# EAGLE board Resistor_Resistor (EAGLE 8.3.0), part 4 of 32
## Placement (x,y rotation side) (continued)
R3936  10K  [0201]  48.51,83.57 0 top
R3937  10K  [0201]  48.51,84.18 0 top
R3938  10K  [0201]  48.51,84.79 0 top
R3939  10K  [0201]  48.51,85.39 0 top
R3940  10K  [0201]  48.51,86 0 top
R3941  10K  [0201]  48.51,86.61 0 top
R3942  10K  [0201]  48.51,87.22 0 top
R3943  10K  [0201]  48.51,87.83 0 top
R3944  10K  [0201]  48.51,88.44 0 top
R3945  10K  [0201]  48.51,89.05 0 top
R3946  10K  [0201]  48.51,89.66 0 top
R3947  10K  [0201]  48.51,90.27 0 top
R3948  10K  [0201]  48.51,90.88 0 top
R3949  10K  [0201]  48.51,91.49 0 top
R3950  10K  [0201]  48.51,92.1 0 top
R3951  10K  [0201]  48.51,92.71 0 top
R3952  10K  [0201]  48.51,93.32 0 top
R3953  10K  [0201]  48.51,93.93 0 top
R3954  10K  [0201]  48.51,94.54 0 top
R3955  10K  [0201]  48.51,95.15 0 top
R3956  10K  [0201]  48.51,95.76 0 top
R3957  10K  [0201]  48.51,96.37 0 top
R3958  10K  [0201]  48.51,96.98 0 top
R3959  10K  [0201]  48.51,97.59 0 top
R3960  10K  [0201]  48.51,98.2 0 top
R3961  10K  [0201]  48.51,98.81 0 top
R3962  10K  [0201]  48.51,99.42 0 top
R3963  10K  [0201]  48.51,100.03 0 top
R3964  10K  [0201]  48.51,100.63 0 top
R3965  10K  [0201]  48.51,101.24 0 top
R3966  10K  [0201]  48.51,101.85 0 top
R3967  10K  [0201]  48.51,102.46 0 top
R3968  10K  [0201]  48.51,103.07 0 top
R3969  10K  [0201]  48.51,103.68 0 top
R3970  10K  [0201]  48.51,104.29 0 top
R3971  10K  [0201]  48.51,104.9 0 top
R3972  10K  [0201]  48.51,105.51 0 top
R3973  10K  [0201]  48.51,106.12 0 top
R3974  10K  [0201]  48.51,106.73 0 top
R3975  10K  [0201]  48.51,107.34 0 top
R3976  10K  [0201]  48.51,107.95 0 top
R3977  10K  [0201]  48.51,108.56 0 top
R3978  10K  [0201]  48.51,109.17 0 top
R3979  10K  [0201]  48.51,109.78 0 top
R3980  10K  [0201]  48.51,110.39 0 top
R3981  10K  [0201]  48.51,111 0 top
R3982  10K  [0201]  48.51,111.61 0 top
R3983  10K  [0201]  48.51,112.22 0 top
R3984  10K  [0201]  48.51,112.83 0 top
R3985  10K  [0201]  48.51,113.44 0 top
R3986  10K  [0201]  48.51,114.05 0 top
R3987  10K  [0201]  48.51,114.66 0 top
R3988  10K  [0201]  48.51,115.27 0 top
R3989  10K  [0201]  48.51,115.87 0 top
R3990  10K  [0201]  48.51,116.48 0 top
R3991  10K  [0201]  48.51,117.09 0 top
R3992  10K  [0201]  48.51,117.7 0 top
R3993  10K  [0201]  48.51,118.31 0 top
R3994  10K  [0201]  48.51,118.92 0 top
R3995  10K  [0201]  48.51,119.53 0 top
R3996  10K  [0201]  48.51,120.14 0 top
R3997  10K  [0201]  48.51,120.75 0 top
R3998  10K  [0201]  48.51,121.36 0 top
R3999  10K  [0201]  48.51,121.97 0 top
R4000  10K  [0201]  48.51,122.58 0 top
R4001  10K  [0201]  49.73,1.27 0 top
R4002  10K  [0201]  49.73,1.88 0 top
R4003  10K  [0201]  49.73,2.49 0 top
R4004  10K  [0201]  49.73,3.1 0 top
R4005  10K  [0201]  49.73,3.71 0 top
R4006  10K  [0201]  49.73,4.32 0 top
R4007  10K  [0201]  49.73,4.93 0 top
R4008  10K  [0201]  49.73,5.54 0 top
R4009  10K  [0201]  49.73,6.15 0 top
R4010  10K  [0201]  49.73,6.76 0 top
R4011  10K  [0201]  49.73,7.37 0 top
R4012  10K  [0201]  49.73,7.98 0 top
R4013  10K  [0201]  49.73,8.59 0 top
R4014  10K  [0201]  49.73,9.19 0 top
R4015  10K  [0201]  49.73,9.8 0 top
R4016  10K  [0201]  49.73,10.41 0 top
R4017  10K  [0201]  49.73,11.02 0 top
R4018  10K  [0201]  49.73,11.63 0 top
R4019  10K  [0201]  49.73,12.24 0 top
R4020  10K  [0201]  49.73,12.85 0 top
R4021  10K  [0201]  49.73,13.46 0 top
R4022  10K  [0201]  49.73,14.07 0 top
R4023  10K  [0201]  49.73,14.68 0 top
R4024  10K  [0201]  49.73,15.29 0 top
R4025  10K  [0201]  49.73,15.9 0 top
R4026  10K  [0201]  49.73,16.51 0 top
R4027  10K  [0201]  49.73,17.12 0 top
R4028  10K  [0201]  49.73,17.73 0 top
R4029  10K  [0201]  49.73,18.34 0 top
R4030  10K  [0201]  49.73,18.95 0 top
R4031  10K  [0201]  49.73,19.56 0 top
R4032  10K  [0201]  49.73,20.17 0 top
R4033  10K  [0201]  49.73,20.78 0 top
R4034  10K  [0201]  49.73,21.39 0 top
R4035  10K  [0201]  49.73,22 0 top
R4036  10K  [0201]  49.73,22.61 0 top
R4037  10K  [0201]  49.73,23.22 0 top
R4038  10K  [0201]  49.73,23.83 0 top
R4039  10K  [0201]  49.73,24.43 0 top
R4040  10K  [0201]  49.73,25.04 0 top
R4041  10K  [0201]  49.73,25.65 0 top
R4042  10K  [0201]  49.73,26.26 0 top
R4043  10K  [0201]  49.73,26.87 0 top
R4044  10K  [0201]  49.73,27.48 0 top
R4045  10K  [0201]  49.73,28.09 0 top
R4046  10K  [0201]  49.73,28.7 0 top
R4047  10K  [0201]  49.73,29.31 0 top
R4048  10K  [0201]  49.73,29.92 0 top
R4049  10K  [0201]  49.73,30.53 0 top
R4050  10K  [0201]  49.73,31.14 0 top
R4051  10K  [0201]  49.73,31.75 0 top
R4052  10K  [0201]  49.73,32.36 0 top
R4053  10K  [0201]  49.73,32.97 0 top
R4054  10K  [0201]  49.73,33.58 0 top
R4055  10K  [0201]  49.73,34.19 0 top
R4056  10K  [0201]  49.73,34.8 0 top
R4057  10K  [0201]  49.73,35.41 0 top
R4058  10K  [0201]  49.73,36.02 0 top
R4059  10K  [0201]  49.73,36.63 0 top
R4060  10K  [0201]  49.73,37.24 0 top
R4061  10K  [0201]  49.73,37.85 0 top
R4062  10K  [0201]  49.73,38.46 0 top
R4063  10K  [0201]  49.73,39.07 0 top
R4064  10K  [0201]  49.73,39.67 0 top
R4065  10K  [0201]  49.73,40.28 0 top
R4066  10K  [0201]  49.73,40.89 0 top
R4067  10K  [0201]  49.73,41.5 0 top
R4068  10K  [0201]  49.73,42.11 0 top
R4069  10K  [0201]  49.73,42.72 0 top
R4070  10K  [0201]  49.73,43.33 0 top
R4071  10K  [0201]  49.73,43.94 0 top
R4072  10K  [0201]  49.73,44.55 0 top
R4073  10K  [0201]  49.73,45.16 0 top
R4074  10K  [0201]  49.73,45.77 0 top
R4075  10K  [0201]  49.73,46.38 0 top
R4076  10K  [0201]  49.73,46.99 0 top
R4077  10K  [0201]  49.73,47.6 0 top
R4078  10K  [0201]  49.73,48.21 0 top
R4079  10K  [0201]  49.73,48.82 0 top
R4080  10K  [0201]  49.73,49.43 0 top
R4081  10K  [0201]  49.73,50.04 0 top
R4082  10K  [0201]  49.73,50.65 0 top
R4083  10K  [0201]  49.73,51.26 0 top
R4084  10K  [0201]  49.73,51.87 0 top
R4085  10K  [0201]  49.73,52.48 0 top
R4086  10K  [0201]  49.73,53.09 0 top
R4087  10K  [0201]  49.73,53.7 0 top
R4088  10K  [0201]  49.73,54.31 0 top
R4089  10K  [0201]  49.73,54.91 0 top
R4090  10K  [0201]  49.73,55.52 0 top
R4091  10K  [0201]  49.73,56.13 0 top
R4092  10K  [0201]  49.73,56.74 0 top
R4093  10K  [0201]  49.73,57.35 0 top
R4094  10K  [0201]  49.73,57.96 0 top
R4095  10K  [0201]  49.73,58.57 0 top
R4096  10K  [0201]  49.73,59.18 0 top
R4097  10K  [0201]  49.73,59.79 0 top
R4098  10K  [0201]  49.73,60.4 0 top
R4099  10K  [0201]  49.73,61.01 0 top
R4100  10K  [0201]  49.73,61.62 0 top
R4101  10K  [0201]  49.73,62.23 0 top
R4102  10K  [0201]  49.73,62.84 0 top
R4103  10K  [0201]  49.73,63.45 0 top
R4104  10K  [0201]  49.73,64.06 0 top
R4105  10K  [0201]  49.73,64.67 0 top
R4106  10K  [0201]  49.73,65.28 0 top
R4107  10K  [0201]  49.73,65.89 0 top
R4108  10K  [0201]  49.73,66.5 0 top
R4109  10K  [0201]  49.73,67.11 0 top
R4110  10K  [0201]  49.73,67.72 0 top
R4111  10K  [0201]  49.73,68.33 0 top
R4112  10K  [0201]  49.73,68.94 0 top
R4113  10K  [0201]  49.73,69.55 0 top
R4114  10K  [0201]  49.73,70.15 0 top
R4115  10K  [0201]  49.73,70.76 0 top
R4116  10K  [0201]  49.73,71.37 0 top
R4117  10K  [0201]  49.73,71.98 0 top
R4118  10K  [0201]  49.73,72.59 0 top
R4119  10K  [0201]  49.73,73.2 0 top
R4120  10K  [0201]  49.73,73.81 0 top
R4121  10K  [0201]  49.73,74.42 0 top
R4122  10K  [0201]  49.73,75.03 0 top
R4123  10K  [0201]  49.73,75.64 0 top
R4124  10K  [0201]  49.73,76.25 0 top
R4125  10K  [0201]  49.73,76.86 0 top
R4126  10K  [0201]  49.73,77.47 0 top
R4127  10K  [0201]  49.73,78.08 0 top
R4128  10K  [0201]  49.73,78.69 0 top
R4129  10K  [0201]  49.73,79.3 0 top
R4130  10K  [0201]  49.73,79.91 0 top
R4131  10K  [0201]  49.73,80.52 0 top
R4132  10K  [0201]  49.73,81.13 0 top
R4133  10K  [0201]  49.73,81.74 0 top
R4134  10K  [0201]  49.73,82.35 0 top
R4135  10K  [0201]  49.73,82.96 0 top
R4136  10K  [0201]  49.73,83.57 0 top
R4137  10K  [0201]  49.73,84.18 0 top
R4138  10K  [0201]  49.73,84.79 0 top
R4139  10K  [0201]  49.73,85.39 0 top
R4140  10K  [0201]  49.73,86 0 top
R4141  10K  [0201]  49.73,86.61 0 top
R4142  10K  [0201]  49.73,87.22 0 top
R4143  10K  [0201]  49.73,87.83 0 top
R4144  10K  [0201]  49.73,88.44 0 top
R4145  10K  [0201]  49.73,89.05 0 top
R4146  10K  [0201]  49.73,89.66 0 top
R4147  10K  [0201]  49.73,90.27 0 top
R4148  10K  [0201]  49.73,90.88 0 top
R4149  10K  [0201]  49.73,91.49 0 top
R4150  10K  [0201]  49.73,92.1 0 top
R4151  10K  [0201]  49.73,92.71 0 top
R4152  10K  [0201]  49.73,93.32 0 top
R4153  10K  [0201]  49.73,93.93 0 top
R4154  10K  [0201]  49.73,94.54 0 top
R4155  10K  [0201]  49.73,95.15 0 top
R4156  10K  [0201]  49.73,95.76 0 top
R4157  10K  [0201]  49.73,96.37 0 top
R4158  10K  [0201]  49.73,96.98 0 top
R4159  10K  [0201]  49.73,97.59 0 top
R4160  10K  [0201]  49.73,98.2 0 top
R4161  10K  [0201]  49.73,98.81 0 top
R4162  10K  [0201]  49.73,99.42 0 top
R4163  10K  [0201]  49.73,100.03 0 top
R4164  10K  [0201]  49.73,100.63 0 top
R4165  10K  [0201]  49.73,101.24 0 top
R4166  10K  [0201]  49.73,101.85 0 top
R4167  10K  [0201]  49.73,102.46 0 top
R4168  10K  [0201]  49.73,103.07 0 top
R4169  10K  [0201]  49.73,103.68 0 top
R4170  10K  [0201]  49.73,104.29 0 top
R4171  10K  [0201]  49.73,104.9 0 top
R4172  10K  [0201]  49.73,105.51 0 top
R4173  10K  [0201]  49.73,106.12 0 top
R4174  10K  [0201]  49.73,106.73 0 top
R4175  10K  [0201]  49.73,107.34 0 top
R4176  10K  [0201]  49.73,107.95 0 top
R4177  10K  [0201]  49.73,108.56 0 top
R4178  10K  [0201]  49.73,109.17 0 top
R4179  10K  [0201]  49.73,109.78 0 top
R4180  10K  [0201]  49.73,110.39 0 top
R4181  10K  [0201]  49.73,111 0 top
R4182  10K  [0201]  49.73,111.61 0 top
R4183  10K  [0201]  49.73,112.22 0 top
R4184  10K  [0201]  49.73,112.83 0 top
R4185  10K  [0201]  49.73,113.44 0 top
R4186  10K  [0201]  49.73,114.05 0 top
R4187  10K  [0201]  49.73,114.66 0 top
R4188  10K  [0201]  49.73,115.27 0 top
R4189  10K  [0201]  49.73,115.87 0 top
R4190  10K  [0201]  49.73,116.48 0 top
R4191  10K  [0201]  49.73,117.09 0 top
R4192  10K  [0201]  49.73,117.7 0 top
R4193  10K  [0201]  49.73,118.31 0 top
R4194  10K  [0201]  49.73,118.92 0 top
R4195  10K  [0201]  49.73,119.53 0 top
R4196  10K  [0201]  49.73,120.14 0 top
R4197  10K  [0201]  49.73,120.75 0 top
R4198  10K  [0201]  49.73,121.36 0 top
R4199  10K  [0201]  49.73,121.97 0 top
R4200  10K  [0201]  49.73,122.58 0 top
R4201  10K  [0201]  50.95,1.27 0 top
R4202  10K  [0201]  50.95,1.88 0 top
R4203  10K  [0201]  50.95,2.49 0 top
R4204  10K  [0201]  50.95,3.1 0 top
R4205  10K  [0201]  50.95,3.71 0 top
R4206  10K  [0201]  50.95,4.32 0 top
R4207  10K  [0201]  50.95,4.93 0 top
R4208  10K  [0201]  50.95,5.54 0 top
R4209  10K  [0201]  50.95,6.15 0 top
R4210  10K  [0201]  50.95,6.76 0 top
R4211  10K  [0201]  50.95,7.37 0 top
R4212  10K  [0201]  50.95,7.98 0 top
R4213  10K  [0201]  50.95,8.59 0 top
R4214  10K  [0201]  50.95,9.19 0 top
R4215  10K  [0201]  50.95,9.8 0 top
R4216  10K  [0201]  50.95,10.41 0 top
R4217  10K  [0201]  50.95,11.02 0 top
R4218  10K  [0201]  50.95,11.63 0 top
R4219  10K  [0201]  50.95,12.24 0 top
R4220  10K  [0201]  50.95,12.85 0 top
R4221  10K  [0201]  50.95,13.46 0 top
R4222  10K  [0201]  50.95,14.07 0 top
R4223  10K  [0201]  50.95,14.68 0 top
R4224  10K  [0201]  50.95,15.29 0 top
R4225  10K  [0201]  50.95,15.9 0 top
R4226  10K  [0201]  50.95,16.51 0 top
R4227  10K  [0201]  50.95,17.12 0 top
R4228  10K  [0201]  50.95,17.73 0 top
R4229  10K  [0201]  50.95,18.34 0 top
R4230  10K  [0201]  50.95,18.95 0 top
R4231  10K  [0201]  50.95,19.56 0 top
R4232  10K  [0201]  50.95,20.17 0 top
R4233  10K  [0201]  50.95,20.78 0 top
R4234  10K  [0201]  50.95,21.39 0 top
R4235  10K  [0201]  50.95,22 0 top
R4236  10K  [0201]  50.95,22.61 0 top
R4237  10K  [0201]  50.95,23.22 0 top
R4238  10K  [0201]  50.95,23.83 0 top
R4239  10K  [0201]  50.95,24.43 0 top
R4240  10K  [0201]  50.95,25.04 0 top
R4241  10K  [0201]  50.95,25.65 0 top
R4242  10K  [0201]  50.95,26.26 0 top
R4243  10K  [0201]  50.95,26.87 0 top
R4244  10K  [0201]  50.95,27.48 0 top
R4245  10K  [0201]  50.95,28.09 0 top
R4246  10K  [0201]  50.95,28.7 0 top
R4247  10K  [0201]  50.95,29.31 0 top
R4248  10K  [0201]  50.95,29.92 0 top
R4249  10K  [0201]  50.95,30.53 0 top
R4250  10K  [0201]  50.95,31.14 0 top
R4251  10K  [0201]  50.95,31.75 0 top
R4252  10K  [0201]  50.95,32.36 0 top
R4253  10K  [0201]  50.95,32.97 0 top
R4254  10K  [0201]  50.95,33.58 0 top
R4255  10K  [0201]  50.95,34.19 0 top
R4256  10K  [0201]  50.95,34.8 0 top
R4257  10K  [0201]  50.95,35.41 0 top
R4258  10K  [0201]  50.95,36.02 0 top
R4259  10K  [0201]  50.95,36.63 0 top
R4260  10K  [0201]  50.95,37.24 0 top
R4261  10K  [0201]  50.95,37.85 0 top
R4262  10K  [0201]  50.95,38.46 0 top
R4263  10K  [0201]  50.95,39.07 0 top
R4264  10K  [0201]  50.95,39.67 0 top
R4265  10K  [0201]  50.95,40.28 0 top
R4266  10K  [0201]  50.95,40.89 0 top
R4267  10K  [0201]  50.95,41.5 0 top
R4268  10K  [0201]  50.95,42.11 0 top
R4269  10K  [0201]  50.95,42.72 0 top
R4270  10K  [0201]  50.95,43.33 0 top
R4271  10K  [0201]  50.95,43.94 0 top
R4272  10K  [0201]  50.95,44.55 0 top
R4273  10K  [0201]  50.95,45.16 0 top
R4274  10K  [0201]  50.95,45.77 0 top
R4275  10K  [0201]  50.95,46.38 0 top
R4276  10K  [0201]  50.95,46.99 0 top
R4277  10K  [0201]  50.95,47.6 0 top
R4278  10K  [0201]  50.95,48.21 0 top
R4279  10K  [0201]  50.95,48.82 0 top
R4280  10K  [0201]  50.95,49.43 0 top
R4281  10K  [0201]  50.95,50.04 0 top
R4282  10K  [0201]  50.95,50.65 0 top
R4283  10K  [0201]  50.95,51.26 0 top
R4284  10K  [0201]  50.95,51.87 0 top
R4285  10K  [0201]  50.95,52.48 0 top
R4286  10K  [0201]  50.95,53.09 0 top
R4287  10K  [0201]  50.95,53.7 0 top
R4288  10K  [0201]  50.95,54.31 0 top
R4289  10K  [0201]  50.95,54.91 0 top
R4290  10K  [0201]  50.95,55.52 0 top
R4291  10K  [0201]  50.95,56.13 0 top
R4292  10K  [0201]  50.95,56.74 0 top
R4293  10K  [0201]  50.95,57.35 0 top
R4294  10K  [0201]  50.95,57.96 0 top
R4295  10K  [0201]  50.95,58.57 0 top
R4296  10K  [0201]  50.95,59.18 0 top
R4297  10K  [0201]  50.95,59.79 0 top
R4298  10K  [0201]  50.95,60.4 0 top
R4299  10K  [0201]  50.95,61.01 0 top
R4300  10K  [0201]  50.95,61.62 0 top
R4301  10K  [0201]  50.95,62.23 0 top
R4302  10K  [0201]  50.95,62.84 0 top
R4303  10K  [0201]  50.95,63.45 0 top
R4304  10K  [0201]  50.95,64.06 0 top
R4305  10K  [0201]  50.95,64.67 0 top
R4306  10K  [0201]  50.95,65.28 0 top
R4307  10K  [0201]  50.95,65.89 0 top
R4308  10K  [0201]  50.95,66.5 0 top
R4309  10K  [0201]  50.95,67.11 0 top
R4310  10K  [0201]  50.95,67.72 0 top
R4311  10K  [0201]  50.95,68.33 0 top
R4312  10K  [0201]  50.95,68.94 0 top
R4313  10K  [0201]  50.95,69.55 0 top
R4314  10K  [0201]  50.95,70.15 0 top
R4315  10K  [0201]  50.95,70.76 0 top
R4316  10K  [0201]  50.95,71.37 0 top
R4317  10K  [0201]  50.95,71.98 0 top
R4318  10K  [0201]  50.95,72.59 0 top
R4319  10K  [0201]  50.95,73.2 0 top
R4320  10K  [0201]  50.95,73.81 0 top
R4321  10K  [0201]  50.95,74.42 0 top
R4322  10K  [0201]  50.95,75.03 0 top
R4323  10K  [0201]  50.95,75.64 0 top
R4324  10K  [0201]  50.95,76.25 0 top
R4325  10K  [0201]  50.95,76.86 0 top
R4326  10K  [0201]  50.95,77.47 0 top
R4327  10K  [0201]  50.95,78.08 0 top
R4328  10K  [0201]  50.95,78.69 0 top
R4329  10K  [0201]  50.95,79.3 0 top
R4330  10K  [0201]  50.95,79.91 0 top
R4331  10K  [0201]  50.95,80.52 0 top
R4332  10K  [0201]  50.95,81.13 0 top
R4333  10K  [0201]  50.95,81.74 0 top
R4334  10K  [0201]  50.95,82.35 0 top
R4335  10K  [0201]  50.95,82.96 0 top
R4336  10K  [0201]  50.95,83.57 0 top
R4337  10K  [0201]  50.95,84.18 0 top
R4338  10K  [0201]  50.95,84.79 0 top
R4339  10K  [0201]  50.95,85.39 0 top
R4340  10K  [0201]  50.95,86 0 top
R4341  10K  [0201]  50.95,86.61 0 top
R4342  10K  [0201]  50.95,87.22 0 top
R4343  10K  [0201]  50.95,87.83 0 top
R4344  10K  [0201]  50.95,88.44 0 top
R4345  10K  [0201]  50.95,89.05 0 top
R4346  10K  [0201]  50.95,89.66 0 top
R4347  10K  [0201]  50.95,90.27 0 top
R4348  10K  [0201]  50.95,90.88 0 top
R4349  10K  [0201]  50.95,91.49 0 top
R4350  10K  [0201]  50.95,92.1 0 top
R4351  10K  [0201]  50.95,92.71 0 top
R4352  10K  [0201]  50.95,93.32 0 top
R4353  10K  [0201]  50.95,93.93 0 top
R4354  10K  [0201]  50.95,94.54 0 top
R4355  10K  [0201]  50.95,95.15 0 top
R4356  10K  [0201]  50.95,95.76 0 top
R4357  10K  [0201]  50.95,96.37 0 top
R4358  10K  [0201]  50.95,96.98 0 top
R4359  10K  [0201]  50.95,97.59 0 top
R4360  10K  [0201]  50.95,98.2 0 top
R4361  10K  [0201]  50.95,98.81 0 top
R4362  10K  [0201]  50.95,99.42 0 top
R4363  10K  [0201]  50.95,100.03 0 top
R4364  10K  [0201]  50.95,100.63 0 top
R4365  10K  [0201]  50.95,101.24 0 top
R4366  10K  [0201]  50.95,101.85 0 top
R4367  10K  [0201]  50.95,102.46 0 top
R4368  10K  [0201]  50.95,103.07 0 top
R4369  10K  [0201]  50.95,103.68 0 top
R4370  10K  [0201]  50.95,104.29 0 top
R4371  10K  [0201]  50.95,104.9 0 top
R4372  10K  [0201]  50.95,105.51 0 top
R4373  10K  [0201]  50.95,106.12 0 top
R4374  10K  [0201]  50.95,106.73 0 top
R4375  10K  [0201]  50.95,107.34 0 top
R4376  10K  [0201]  50.95,107.95 0 top
R4377  10K  [0201]  50.95,108.56 0 top
R4378  10K  [0201]  50.95,109.17 0 top
R4379  10K  [0201]  50.95,109.78 0 top
R4380  10K  [0201]  50.95,110.39 0 top
R4381  10K  [0201]  50.95,111 0 top
R4382  10K  [0201]  50.95,111.61 0 top
R4383  10K  [0201]  50.95,112.22 0 top
R4384  10K  [0201]  50.95,112.83 0 top
R4385  10K  [0201]  50.95,113.44 0 top
R4386  10K  [0201]  50.95,114.05 0 top
R4387  10K  [0201]  50.95,114.66 0 top
R4388  10K  [0201]  50.95,115.27 0 top
R4389  10K  [0201]  50.95,115.87 0 top
R4390  10K  [0201]  50.95,116.48 0 top
R4391  10K  [0201]  50.95,117.09 0 top
R4392  10K  [0201]  50.95,117.7 0 top
R4393  10K  [0201]  50.95,118.31 0 top
R4394  10K  [0201]  50.95,118.92 0 top
R4395  10K  [0201]  50.95,119.53 0 top
R4396  10K  [0201]  50.95,120.14 0 top
R4397  10K  [0201]  50.95,120.75 0 top
R4398  10K  [0201]  50.95,121.36 0 top
R4399  10K  [0201]  50.95,121.97 0 top
R4400  10K  [0201]  50.95,122.58 0 top
R4401  10K  [0201]  52.17,1.27 0 top
R4402  10K  [0201]  52.17,1.88 0 top
R4403  10K  [0201]  52.17,2.49 0 top
R4404  10K  [0201]  52.17,3.1 0 top
R4405  10K  [0201]  52.17,3.71 0 top
R4406  10K  [0201]  52.17,4.32 0 top
R4407  10K  [0201]  52.17,4.93 0 top
R4408  10K  [0201]  52.17,5.54 0 top
R4409  10K  [0201]  52.17,6.15 0 top
R4410  10K  [0201]  52.17,6.76 0 top
R4411  10K  [0201]  52.17,7.37 0 top
R4412  10K  [0201]  52.17,7.98 0 top
R4413  10K  [0201]  52.17,8.59 0 top
R4414  10K  [0201]  52.17,9.19 0 top
R4415  10K  [0201]  52.17,9.8 0 top
R4416  10K  [0201]  52.17,10.41 0 top
R4417  10K  [0201]  52.17,11.02 0 top
R4418  10K  [0201]  52.17,11.63 0 top
R4419  10K  [0201]  52.17,12.24 0 top
R4420  10K  [0201]  52.17,12.85 0 top
R4421  10K  [0201]  52.17,13.46 0 top
R4422  10K  [0201]  52.17,14.07 0 top
R4423  10K  [0201]  52.17,14.68 0 top
R4424  10K  [0201]  52.17,15.29 0 top
R4425  10K  [0201]  52.17,15.9 0 top
R4426  10K  [0201]  52.17,16.51 0 top
R4427  10K  [0201]  52.17,17.12 0 top
R4428  10K  [0201]  52.17,17.73 0 top
R4429  10K  [0201]  52.17,18.34 0 top
R4430  10K  [0201]  52.17,18.95 0 top
R4431  10K  [0201]  52.17,19.56 0 top
R4432  10K  [0201]  52.17,20.17 0 top
R4433  10K  [0201]  52.17,20.78 0 top
R4434  10K  [0201]  52.17,21.39 0 top
R4435  10K  [0201]  52.17,22 0 top
R4436  10K  [0201]  52.17,22.61 0 top
R4437  10K  [0201]  52.17,23.22 0 top
R4438  10K  [0201]  52.17,23.83 0 top
R4439  10K  [0201]  52.17,24.43 0 top
R4440  10K  [0201]  52.17,25.04 0 top
R4441  10K  [0201]  52.17,25.65 0 top
R4442  10K  [0201]  52.17,26.26 0 top
R4443  10K  [0201]  52.17,26.87 0 top
R4444  10K  [0201]  52.17,27.48 0 top
R4445  10K  [0201]  52.17,28.09 0 top
R4446  10K  [0201]  52.17,28.7 0 top
R4447  10K  [0201]  52.17,29.31 0 top
R4448  10K  [0201]  52.17,29.92 0 top
R4449  10K  [0201]  52.17,30.53 0 top
R4450  10K  [0201]  52.17,31.14 0 top
R4451  10K  [0201]  52.17,31.75 0 top
R4452  10K  [0201]  52.17,32.36 0 top
R4453  10K  [0201]  52.17,32.97 0 top
R4454  10K  [0201]  52.17,33.58 0 top
R4455  10K  [0201]  52.17,34.19 0 top
R4456  10K  [0201]  52.17,34.8 0 top
R4457  10K  [0201]  52.17,35.41 0 top
R4458  10K  [0201]  52.17,36.02 0 top
R4459  10K  [0201]  52.17,36.63 0 top
R4460  10K  [0201]  52.17,37.24 0 top
R4461  10K  [0201]  52.17,37.85 0 top
R4462  10K  [0201]  52.17,38.46 0 top
R4463  10K  [0201]  52.17,39.07 0 top
R4464  10K  [0201]  52.17,39.67 0 top
R4465  10K  [0201]  52.17,40.28 0 top
R4466  10K  [0201]  52.17,40.89 0 top
R4467  10K  [0201]  52.17,41.5 0 top
R4468  10K  [0201]  52.17,42.11 0 top
R4469  10K  [0201]  52.17,42.72 0 top
R4470  10K  [0201]  52.17,43.33 0 top
R4471  10K  [0201]  52.17,43.94 0 top
R4472  10K  [0201]  52.17,44.55 0 top
R4473  10K  [0201]  52.17,45.16 0 top
R4474  10K  [0201]  52.17,45.77 0 top
R4475  10K  [0201]  52.17,46.38 0 top
R4476  10K  [0201]  52.17,46.99 0 top
R4477  10K  [0201]  52.17,47.6 0 top
R4478  10K  [0201]  52.17,48.21 0 top
R4479  10K  [0201]  52.17,48.82 0 top
R4480  10K  [0201]  52.17,49.43 0 top
R4481  10K  [0201]  52.17,50.04 0 top
R4482  10K  [0201]  52.17,50.65 0 top
R4483  10K  [0201]  52.17,51.26 0 top
R4484  10K  [0201]  52.17,51.87 0 top
R4485  10K  [0201]  52.17,52.48 0 top
R4486  10K  [0201]  52.17,53.09 0 top
R4487  10K  [0201]  52.17,53.7 0 top
R4488  10K  [0201]  52.17,54.31 0 top
R4489  10K  [0201]  52.17,54.91 0 top
R4490  10K  [0201]  52.17,55.52 0 top
R4491  10K  [0201]  52.17,56.13 0 top
R4492  10K  [0201]  52.17,56.74 0 top
R4493  10K  [0201]  52.17,57.35 0 top
R4494  10K  [0201]  52.17,57.96 0 top
R4495  10K  [0201]  52.17,58.57 0 top
R4496  10K  [0201]  52.17,59.18 0 top
R4497  10K  [0201]  52.17,59.79 0 top
R4498  10K  [0201]  52.17,60.4 0 top
R4499  10K  [0201]  52.17,61.01 0 top
R4500  10K  [0201]  52.17,61.62 0 top
R4501  10K  [0201]  52.17,62.23 0 top
R4502  10K  [0201]  52.17,62.84 0 top
R4503  10K  [0201]  52.17,63.45 0 top
R4504  10K  [0201]  52.17,64.06 0 top
R4505  10K  [0201]  52.17,64.67 0 top
R4506  10K  [0201]  52.17,65.28 0 top
R4507  10K  [0201]  52.17,65.89 0 top
R4508  10K  [0201]  52.17,66.5 0 top
R4509  10K  [0201]  52.17,67.11 0 top
R4510  10K  [0201]  52.17,67.72 0 top
R4511  10K  [0201]  52.17,68.33 0 top
R4512  10K  [0201]  52.17,68.94 0 top
R4513  10K  [0201]  52.17,69.55 0 top
R4514  10K  [0201]  52.17,70.15 0 top
R4515  10K  [0201]  52.17,70.76 0 top
R4516  10K  [0201]  52.17,71.37 0 top
R4517  10K  [0201]  52.17,71.98 0 top
R4518  10K  [0201]  52.17,72.59 0 top
R4519  10K  [0201]  52.17,73.2 0 top
R4520  10K  [0201]  52.17,73.81 0 top
R4521  10K  [0201]  52.17,74.42 0 top
R4522  10K  [0201]  52.17,75.03 0 top
R4523  10K  [0201]  52.17,75.64 0 top
R4524  10K  [0201]  52.17,76.25 0 top
R4525  10K  [0201]  52.17,76.86 0 top
R4526  10K  [0201]  52.17,77.47 0 top
R4527  10K  [0201]  52.17,78.08 0 top
R4528  10K  [0201]  52.17,78.69 0 top
R4529  10K  [0201]  52.17,79.3 0 top
R4530  10K  [0201]  52.17,79.91 0 top
R4531  10K  [0201]  52.17,80.52 0 top
R4532  10K  [0201]  52.17,81.13 0 top
R4533  10K  [0201]  52.17,81.74 0 top
R4534  10K  [0201]  52.17,82.35 0 top
R4535  10K  [0201]  52.17,82.96 0 top
R4536  10K  [0201]  52.17,83.57 0 top
R4537  10K  [0201]  52.17,84.18 0 top
R4538  10K  [0201]  52.17,84.79 0 top
R4539  10K  [0201]  52.17,85.39 0 top
R4540  10K  [0201]  52.17,86 0 top
R4541  10K  [0201]  52.17,86.61 0 top
R4542  10K  [0201]  52.17,87.22 0 top
R4543  10K  [0201]  52.17,87.83 0 top
R4544  10K  [0201]  52.17,88.44 0 top
R4545  10K  [0201]  52.17,89.05 0 top
R4546  10K  [0201]  52.17,89.66 0 top
R4547  10K  [0201]  52.17,90.27 0 top
R4548  10K  [0201]  52.17,90.88 0 top
R4549  10K  [0201]  52.17,91.49 0 top
R4550  10K  [0201]  52.17,92.1 0 top
R4551  10K  [0201]  52.17,92.71 0 top
R4552  10K  [0201]  52.17,93.32 0 top
R4553  10K  [0201]  52.17,93.93 0 top
R4554  10K  [0201]  52.17,94.54 0 top
R4555  10K  [0201]  52.17,95.15 0 top
R4556  10K  [0201]  52.17,95.76 0 top
R4557  10K  [0201]  52.17,96.37 0 top
R4558  10K  [0201]  52.17,96.98 0 top
R4559  10K  [0201]  52.17,97.59 0 top
R4560  10K  [0201]  52.17,98.2 0 top
R4561  10K  [0201]  52.17,98.81 0 top
R4562  10K  [0201]  52.17,99.42 0 top
R4563  10K  [0201]  52.17,100.03 0 top
R4564  10K  [0201]  52.17,100.63 0 top
R4565  10K  [0201]  52.17,101.24 0 top
R4566  10K  [0201]  52.17,101.85 0 top
R4567  10K  [0201]  52.17,102.46 0 top
R4568  10K  [0201]  52.17,103.07 0 top
R4569  10K  [0201]  52.17,103.68 0 top
R4570  10K  [0201]  52.17,104.29 0 top
R4571  10K  [0201]  52.17,104.9 0 top
R4572  10K  [0201]  52.17,105.51 0 top
R4573  10K  [0201]  52.17,106.12 0 top
R4574  10K  [0201]  52.17,106.73 0 top
R4575  10K  [0201]  52.17,107.34 0 top
R4576  10K  [0201]  52.17,107.95 0 top
R4577  10K  [0201]  52.17,108.56 0 top
R4578  10K  [0201]  52.17,109.17 0 top
R4579  10K  [0201]  52.17,109.78 0 top
R4580  10K  [0201]  52.17,110.39 0 top
R4581  10K  [0201]  52.17,111 0 top
R4582  10K  [0201]  52.17,111.61 0 top
R4583  10K  [0201]  52.17,112.22 0 top
R4584  10K  [0201]  52.17,112.83 0 top
R4585  10K  [0201]  52.17,113.44 0 top
R4586  10K  [0201]  52.17,114.05 0 top
R4587  10K  [0201]  52.17,114.66 0 top
R4588  10K  [0201]  52.17,115.27 0 top
R4589  10K  [0201]  52.17,115.87 0 top
R4590  10K  [0201]  52.17,116.48 0 top
R4591  10K  [0201]  52.17,117.09 0 top
R4592  10K  [0201]  52.17,117.7 0 top
R4593  10K  [0201]  52.17,118.31 0 top
R4594  10K  [0201]  52.17,118.92 0 top
R4595  10K  [0201]  52.17,119.53 0 top
R4596  10K  [0201]  52.17,120.14 0 top
R4597  10K  [0201]  52.17,120.75 0 top
R4598  10K  [0201]  52.17,121.36 0 top
R4599  10K  [0201]  52.17,121.97 0 top
R4600  10K  [0201]  52.17,122.58 0 top
R4601  10K  [0201]  53.39,1.27 0 top
R4602  10K  [0201]  53.39,1.88 0 top
R4603  10K  [0201]  53.39,2.49 0 top
R4604  10K  [0201]  53.39,3.1 0 top
R4605  10K  [0201]  53.39,3.71 0 top
R4606  10K  [0201]  53.39,4.32 0 top
R4607  10K  [0201]  53.39,4.93 0 top
R4608  10K  [0201]  53.39,5.54 0 top
R4609  10K  [0201]  53.39,6.15 0 top
R4610  10K  [0201]  53.39,6.76 0 top
R4611  10K  [0201]  53.39,7.37 0 top
R4612  10K  [0201]  53.39,7.98 0 top
R4613  10K  [0201]  53.39,8.59 0 top
R4614  10K  [0201]  53.39,9.19 0 top
R4615  10K  [0201]  53.39,9.8 0 top
R4616  10K  [0201]  53.39,10.41 0 top
R4617  10K  [0201]  53.39,11.02 0 top
R4618  10K  [0201]  53.39,11.63 0 top
R4619  10K  [0201]  53.39,12.24 0 top
R4620  10K  [0201]  53.39,12.85 0 top
R4621  10K  [0201]  53.39,13.46 0 top
R4622  10K  [0201]  53.39,14.07 0 top
R4623  10K  [0201]  53.39,14.68 0 top
R4624  10K  [0201]  53.39,15.29 0 top
R4625  10K  [0201]  53.39,15.9 0 top
R4626  10K  [0201]  53.39,16.51 0 top
R4627  10K  [0201]  53.39,17.12 0 top
R4628  10K  [0201]  53.39,17.73 0 top
R4629  10K  [0201]  53.39,18.34 0 top
R4630  10K  [0201]  53.39,18.95 0 top
R4631  10K  [0201]  53.39,19.56 0 top
R4632  10K  [0201]  53.39,20.17 0 top
R4633  10K  [0201]  53.39,20.78 0 top
R4634  10K  [0201]  53.39,21.39 0 top
R4635  10K  [0201]  53.39,22 0 top
R4636  10K  [0201]  53.39,22.61 0 top
R4637  10K  [0201]  53.39,23.22 0 top
R4638  10K  [0201]  53.39,23.83 0 top
R4639  10K  [0201]  53.39,24.43 0 top
R4640  10K  [0201]  53.39,25.04 0 top
R4641  10K  [0201]  53.39,25.65 0 top
R4642  10K  [0201]  53.39,26.26 0 top
R4643  10K  [0201]  53.39,26.87 0 top
R4644  10K  [0201]  53.39,27.48 0 top
R4645  10K  [0201]  53.39,28.09 0 top
R4646  10K  [0201]  53.39,28.7 0 top
R4647  10K  [0201]  53.39,29.31 0 top
R4648  10K  [0201]  53.39,29.92 0 top
R4649  10K  [0201]  53.39,30.53 0 top
R4650  10K  [0201]  53.39,31.14 0 top
R4651  10K  [0201]  53.39,31.75 0 top
R4652  10K  [0201]  53.39,32.36 0 top
R4653  10K  [0201]  53.39,32.97 0 top
R4654  10K  [0201]  53.39,33.58 0 top
R4655  10K  [0201]  53.39,34.19 0 top
R4656  10K  [0201]  53.39,34.8 0 top
R4657  10K  [0201]  53.39,35.41 0 top
R4658  10K  [0201]  53.39,36.02 0 top
R4659  10K  [0201]  53.39,36.63 0 top
R4660  10K  [0201]  53.39,37.24 0 top
R4661  10K  [0201]  53.39,37.85 0 top
R4662  10K  [0201]  53.39,38.46 0 top
R4663  10K  [0201]  53.39,39.07 0 top
R4664  10K  [0201]  53.39,39.67 0 top
R4665  10K  [0201]  53.39,40.28 0 top
R4666  10K  [0201]  53.39,40.89 0 top
R4667  10K  [0201]  53.39,41.5 0 top
R4668  10K  [0201]  53.39,42.11 0 top
R4669  10K  [0201]  53.39,42.72 0 top
R4670  10K  [0201]  53.39,43.33 0 top
R4671  10K  [0201]  53.39,43.94 0 top
R4672  10K  [0201]  53.39,44.55 0 top
R4673  10K  [0201]  53.39,45.16 0 top
R4674  10K  [0201]  53.39,45.77 0 top
R4675  10K  [0201]  53.39,46.38 0 top
R4676  10K  [0201]  53.39,46.99 0 top
R4677  10K  [0201]  53.39,47.6 0 top
R4678  10K  [0201]  53.39,48.21 0 top
R4679  10K  [0201]  53.39,48.82 0 top
R4680  10K  [0201]  53.39,49.43 0 top
R4681  10K  [0201]  53.39,50.04 0 top
R4682  10K  [0201]  53.39,50.65 0 top
R4683  10K  [0201]  53.39,51.26 0 top
R4684  10K  [0201]  53.39,51.87 0 top
R4685  10K  [0201]  53.39,52.48 0 top
R4686  10K  [0201]  53.39,53.09 0 top
R4687  10K  [0201]  53.39,53.7 0 top
R4688  10K  [0201]  53.39,54.31 0 top
R4689  10K  [0201]  53.39,54.91 0 top
R4690  10K  [0201]  53.39,55.52 0 top
R4691  10K  [0201]  53.39,56.13 0 top
R4692  10K  [0201]  53.39,56.74 0 top
R4693  10K  [0201]  53.39,57.35 0 top
R4694  10K  [0201]  53.39,57.96 0 top
R4695  10K  [0201]  53.39,58.57 0 top
R4696  10K  [0201]  53.39,59.18 0 top
R4697  10K  [0201]  53.39,59.79 0 top
R4698  10K  [0201]  53.39,60.4 0 top
R4699  10K  [0201]  53.39,61.01 0 top
R4700  10K  [0201]  53.39,61.62 0 top
R4701  10K  [0201]  53.39,62.23 0 top
R4702  10K  [0201]  53.39,62.84 0 top
R4703  10K  [0201]  53.39,63.45 0 top
R4704  10K  [0201]  53.39,64.06 0 top
R4705  10K  [0201]  53.39,64.67 0 top
R4706  10K  [0201]  53.39,65.28 0 top
R4707  10K  [0201]  53.39,65.89 0 top
R4708  10K  [0201]  53.39,66.5 0 top
R4709  10K  [0201]  53.39,67.11 0 top
R4710  10K  [0201]  53.39,67.72 0 top
R4711  10K  [0201]  53.39,68.33 0 top
R4712  10K  [0201]  53.39,68.94 0 top
R4713  10K  [0201]  53.39,69.55 0 top
R4714  10K  [0201]  53.39,70.15 0 top
R4715  10K  [0201]  53.39,70.76 0 top
R4716  10K  [0201]  53.39,71.37 0 top
R4717  10K  [0201]  53.39,71.98 0 top
R4718  10K  [0201]  53.39,72.59 0 top
R4719  10K  [0201]  53.39,73.2 0 top
R4720  10K  [0201]  53.39,73.81 0 top
R4721  10K  [0201]  53.39,74.42 0 top
R4722  10K  [0201]  53.39,75.03 0 top
R4723  10K  [0201]  53.39,75.64 0 top
R4724  10K  [0201]  53.39,76.25 0 top
R4725  10K  [0201]  53.39,76.86 0 top
R4726  10K  [0201]  53.39,77.47 0 top
R4727  10K  [0201]  53.39,78.08 0 top
R4728  10K  [0201]  53.39,78.69 0 top
R4729  10K  [0201]  53.39,79.3 0 top
R4730  10K  [0201]  53.39,79.91 0 top
R4731  10K  [0201]  53.39,80.52 0 top
R4732  10K  [0201]  53.39,81.13 0 top
R4733  10K  [0201]  53.39,81.74 0 top
R4734  10K  [0201]  53.39,82.35 0 top
R4735  10K  [0201]  53.39,82.96 0 top
R4736  10K  [0201]  53.39,83.57 0 top
R4737  10K  [0201]  53.39,84.18 0 top
R4738  10K  [0201]  53.39,84.79 0 top
R4739  10K  [0201]  53.39,85.39 0 top
R4740  10K  [0201]  53.39,86 0 top
R4741  10K  [0201]  53.39,86.61 0 top
R4742  10K  [0201]  53.39,87.22 0 top
R4743  10K  [0201]  53.39,87.83 0 top
R4744  10K  [0201]  53.39,88.44 0 top
R4745  10K  [0201]  53.39,89.05 0 top
R4746  10K  [0201]  53.39,89.66 0 top
R4747  10K  [0201]  53.39,90.27 0 top
R4748  10K  [0201]  53.39,90.88 0 top
R4749  10K  [0201]  53.39,91.49 0 top
R4750  10K  [0201]  53.39,92.1 0 top
R4751  10K  [0201]  53.39,92.71 0 top
R4752  10K  [0201]  53.39,93.32 0 top
R4753  10K  [0201]  53.39,93.93 0 top
R4754  10K  [0201]  53.39,94.54 0 top
R4755  10K  [0201]  53.39,95.15 0 top
R4756  10K  [0201]  53.39,95.76 0 top
R4757  10K  [0201]  53.39,96.37 0 top
R4758  10K  [0201]  53.39,96.98 0 top
R4759  10K  [0201]  53.39,97.59 0 top
R4760  10K  [0201]  53.39,98.2 0 top
R4761  10K  [0201]  53.39,98.81 0 top
R4762  10K  [0201]  53.39,99.42 0 top
R4763  10K  [0201]  53.39,100.03 0 top
R4764  10K  [0201]  53.39,100.63 0 top
R4765  10K  [0201]  53.39,101.24 0 top
R4766  10K  [0201]  53.39,101.85 0 top
R4767  10K  [0201]  53.39,102.46 0 top
R4768  10K  [0201]  53.39,103.07 0 top
R4769  10K  [0201]  53.39,103.68 0 top
R4770  10K  [0201]  53.39,104.29 0 top
R4771  10K  [0201]  53.39,104.9 0 top
R4772  10K  [0201]  53.39,105.51 0 top
R4773  10K  [0201]  53.39,106.12 0 top
R4774  10K  [0201]  53.39,106.73 0 top
R4775  10K  [0201]  53.39,107.34 0 top
R4776  10K  [0201]  53.39,107.95 0 top
R4777  10K  [0201]  53.39,108.56 0 top
R4778  10K  [0201]  53.39,109.17 0 top
R4779  10K  [0201]  53.39,109.78 0 top
R4780  10K  [0201]  53.39,110.39 0 top
R4781  10K  [0201]  53.39,111 0 top
R4782  10K  [0201]  53.39,111.61 0 top
R4783  10K  [0201]  53.39,112.22 0 top
R4784  10K  [0201]  53.39,112.83 0 top
R4785  10K  [0201]  53.39,113.44 0 top
R4786  10K  [0201]  53.39,114.05 0 top
R4787  10K  [0201]  53.39,114.66 0 top
R4788  10K  [0201]  53.39,115.27 0 top
R4789  10K  [0201]  53.39,115.87 0 top
R4790  10K  [0201]  53.39,116.48 0 top
R4791  10K  [0201]  53.39,117.09 0 top
R4792  10K  [0201]  53.39,117.7 0 top
R4793  10K  [0201]  53.39,118.31 0 top
R4794  10K  [0201]  53.39,118.92 0 top
R4795  10K  [0201]  53.39,119.53 0 top
R4796  10K  [0201]  53.39,120.14 0 top
R4797  10K  [0201]  53.39,120.75 0 top
R4798  10K  [0201]  53.39,121.36 0 top
R4799  10K  [0201]  53.39,121.97 0 top
R4800  10K  [0201]  53.39,122.58 0 top
R4801  10K  [0201]  54.61,1.27 0 top
R4802  10K  [0201]  54.61,1.88 0 top
R4803  10K  [0201]  54.61,2.49 0 top
R4804  10K  [0201]  54.61,3.1 0 top
R4805  10K  [0201]  54.61,3.71 0 top
R4806  10K  [0201]  54.61,4.32 0 top
R4807  10K  [0201]  54.61,4.93 0 top
R4808  10K  [0201]  54.61,5.54 0 top
R4809  10K  [0201]  54.61,6.15 0 top
R4810  10K  [0201]  54.61,6.76 0 top
R4811  10K  [0201]  54.61,7.37 0 top
R4812  10K  [0201]  54.61,7.98 0 top
R4813  10K  [0201]  54.61,8.59 0 top
R4814  10K  [0201]  54.61,9.19 0 top
R4815  10K  [0201]  54.61,9.8 0 top
R4816  10K  [0201]  54.61,10.41 0 top
R4817  10K  [0201]  54.61,11.02 0 top
R4818  10K  [0201]  54.61,11.63 0 top
R4819  10K  [0201]  54.61,12.24 0 top
R4820  10K  [0201]  54.61,12.85 0 top
R4821  10K  [0201]  54.61,13.46 0 top
R4822  10K  [0201]  54.61,14.07 0 top
R4823  10K  [0201]  54.61,14.68 0 top
R4824  10K  [0201]  54.61,15.29 0 top
R4825  10K  [0201]  54.61,15.9 0 top
R4826  10K  [0201]  54.61,16.51 0 top
R4827  10K  [0201]  54.61,17.12 0 top
R4828  10K  [0201]  54.61,17.73 0 top
R4829  10K  [0201]  54.61,18.34 0 top
R4830  10K  [0201]  54.61,18.95 0 top
R4831  10K  [0201]  54.61,19.56 0 top
R4832  10K  [0201]  54.61,20.17 0 top
R4833  10K  [0201]  54.61,20.78 0 top
R4834  10K  [0201]  54.61,21.39 0 top
R4835  10K  [0201]  54.61,22 0 top
R4836  10K  [0201]  54.61,22.61 0 top
R4837  10K  [0201]  54.61,23.22 0 top
R4838  10K  [0201]  54.61,23.83 0 top
R4839  10K  [0201]  54.61,24.43 0 top
R4840  10K  [0201]  54.61,25.04 0 top
R4841  10K  [0201]  54.61,25.65 0 top
R4842  10K  [0201]  54.61,26.26 0 top
R4843  10K  [0201]  54.61,26.87 0 top
R4844  10K  [0201]  54.61,27.48 0 top
R4845  10K  [0201]  54.61,28.09 0 top
R4846  10K  [0201]  54.61,28.7 0 top
R4847  10K  [0201]  54.61,29.31 0 top
R4848  10K  [0201]  54.61,29.92 0 top
R4849  10K  [0201]  54.61,30.53 0 top
R4850  10K  [0201]  54.61,31.14 0 top
R4851  10K  [0201]  54.61,31.75 0 top
R4852  10K  [0201]  54.61,32.36 0 top
R4853  10K  [0201]  54.61,32.97 0 top
R4854  10K  [0201]  54.61,33.58 0 top
R4855  10K  [0201]  54.61,34.19 0 top
R4856  10K  [0201]  54.61,34.8 0 top
R4857  10K  [0201]  54.61,35.41 0 top
R4858  10K  [0201]  54.61,36.02 0 top
R4859  10K  [0201]  54.61,36.63 0 top
R4860  10K  [0201]  54.61,37.24 0 top
R4861  10K  [0201]  54.61,37.85 0 top
R4862  10K  [0201]  54.61,38.46 0 top
R4863  10K  [0201]  54.61,39.07 0 top
R4864  10K  [0201]  54.61,39.67 0 top
R4865  10K  [0201]  54.61,40.28 0 top
R4866  10K  [0201]  54.61,40.89 0 top
R4867  10K  [0201]  54.61,41.5 0 top
R4868  10K  [0201]  54.61,42.11 0 top
R4869  10K  [0201]  54.61,42.72 0 top
R4870  10K  [0201]  54.61,43.33 0 top
R4871  10K  [0201]  54.61,43.94 0 top
R4872  10K  [0201]  54.61,44.55 0 top
R4873  10K  [0201]  54.61,45.16 0 top
R4874  10K  [0201]  54.61,45.77 0 top
R4875  10K  [0201]  54.61,46.38 0 top
R4876  10K  [0201]  54.61,46.99 0 top
R4877  10K  [0201]  54.61,47.6 0 top
R4878  10K  [0201]  54.61,48.21 0 top
R4879  10K  [0201]  54.61,48.82 0 top
R4880  10K  [0201]  54.61,49.43 0 top
R4881  10K  [0201]  54.61,50.04 0 top
R4882  10K  [0201]  54.61,50.65 0 top
R4883  10K  [0201]  54.61,51.26 0 top
R4884  10K  [0201]  54.61,51.87 0 top
R4885  10K  [0201]  54.61,52.48 0 top
R4886  10K  [0201]  54.61,53.09 0 top
R4887  10K  [0201]  54.61,53.7 0 top
R4888  10K  [0201]  54.61,54.31 0 top
R4889  10K  [0201]  54.61,54.91 0 top
R4890  10K  [0201]  54.61,55.52 0 top
R4891  10K  [0201]  54.61,56.13 0 top
R4892  10K  [0201]  54.61,56.74 0 top
R4893  10K  [0201]  54.61,57.35 0 top
R4894  10K  [0201]  54.61,57.96 0 top
R4895  10K  [0201]  54.61,58.57 0 top
R4896  10K  [0201]  54.61,59.18 0 top
R4897  10K  [0201]  54.61,59.79 0 top
R4898  10K  [0201]  54.61,60.4 0 top
R4899  10K  [0201]  54.61,61.01 0 top
R4900  10K  [0201]  54.61,61.62 0 top
R4901  10K  [0201]  54.61,62.23 0 top
R4902  10K  [0201]  54.61,62.84 0 top
R4903  10K  [0201]  54.61,63.45 0 top
R4904  10K  [0201]  54.61,64.06 0 top
R4905  10K  [0201]  54.61,64.67 0 top
R4906  10K  [0201]  54.61,65.28 0 top
R4907  10K  [0201]  54.61,65.89 0 top
R4908  10K  [0201]  54.61,66.5 0 top
R4909  10K  [0201]  54.61,67.11 0 top
R4910  10K  [0201]  54.61,67.72 0 top
R4911  10K  [0201]  54.61,68.33 0 top
R4912  10K  [0201]  54.61,68.94 0 top
R4913  10K  [0201]  54.61,69.55 0 top
R4914  10K  [0201]  54.61,70.15 0 top
R4915  10K  [0201]  54.61,70.76 0 top
R4916  10K  [0201]  54.61,71.37 0 top
R4917  10K  [0201]  54.61,71.98 0 top
R4918  10K  [0201]  54.61,72.59 0 top
R4919  10K  [0201]  54.61,73.2 0 top
R4920  10K  [0201]  54.61,73.81 0 top
R4921  10K  [0201]  54.61,74.42 0 top
R4922  10K  [0201]  54.61,75.03 0 top
R4923  10K  [0201]  54.61,75.64 0 top
R4924  10K  [0201]  54.61,76.25 0 top
R4925  10K  [0201]  54.61,76.86 0 top
R4926  10K  [0201]  54.61,77.47 0 top
R4927  10K  [0201]  54.61,78.08 0 top
R4928  10K  [0201]  54.61,78.69 0 top
R4929  10K  [0201]  54.61,79.3 0 top
R4930  10K  [0201]  54.61,79.91 0 top
R4931  10K  [0201]  54.61,80.52 0 top
R4932  10K  [0201]  54.61,81.13 0 top
R4933  10K  [0201]  54.61,81.74 0 top
R4934  10K  [0201]  54.61,82.35 0 top
R4935  10K  [0201]  54.61,82.96 0 top
R4936  10K  [0201]  54.61,83.57 0 top
R4937  10K  [0201]  54.61,84.18 0 top
R4938  10K  [0201]  54.61,84.79 0 top
R4939  10K  [0201]  54.61,85.39 0 top
R4940  10K  [0201]  54.61,86 0 top
R4941  10K  [0201]  54.61,86.61 0 top
R4942  10K  [0201]  54.61,87.22 0 top
R4943  10K  [0201]  54.61,87.83 0 top
R4944  10K  [0201]  54.61,88.44 0 top
R4945  10K  [0201]  54.61,89.05 0 top
R4946  10K  [0201]  54.61,89.66 0 top
R4947  10K  [0201]  54.61,90.27 0 top
R4948  10K  [0201]  54.61,90.88 0 top
R4949  10K  [0201]  54.61,91.49 0 top
R4950  10K  [0201]  54.61,92.1 0 top
R4951  10K  [0201]  54.61,92.71 0 top
R4952  10K  [0201]  54.61,93.32 0 top
R4953  10K  [0201]  54.61,93.93 0 top
R4954  10K  [0201]  54.61,94.54 0 top
R4955  10K  [0201]  54.61,95.15 0 top
R4956  10K  [0201]  54.61,95.76 0 top
R4957  10K  [0201]  54.61,96.37 0 top
R4958  10K  [0201]  54.61,96.98 0 top
R4959  10K  [0201]  54.61,97.59 0 top
R4960  10K  [0201]  54.61,98.2 0 top
R4961  10K  [0201]  54.61,98.81 0 top
R4962  10K  [0201]  54.61,99.42 0 top
R4963  10K  [0201]  54.61,100.03 0 top
R4964  10K  [0201]  54.61,100.63 0 top
R4965  10K  [0201]  54.61,101.24 0 top
R4966  10K  [0201]  54.61,101.85 0 top
R4967  10K  [0201]  54.61,102.46 0 top
R4968  10K  [0201]  54.61,103.07 0 top
R4969  10K  [0201]  54.61,103.68 0 top
R4970  10K  [0201]  54.61,104.29 0 top
R4971  10K  [0201]  54.61,104.9 0 top
R4972  10K  [0201]  54.61,105.51 0 top
R4973  10K  [0201]  54.61,106.12 0 top
R4974  10K  [0201]  54.61,106.73 0 top
R4975  10K  [0201]  54.61,107.34 0 top
R4976  10K  [0201]  54.61,107.95 0 top
R4977  10K  [0201]  54.61,108.56 0 top
R4978  10K  [0201]  54.61,109.17 0 top
R4979  10K  [0201]  54.61,109.78 0 top
R4980  10K  [0201]  54.61,110.39 0 top
R4981  10K  [0201]  54.61,111 0 top
R4982  10K  [0201]  54.61,111.61 0 top
R4983  10K  [0201]  54.61,112.22 0 top
R4984  10K  [0201]  54.61,112.83 0 top
R4985  10K  [0201]  54.61,113.44 0 top
R4986  10K  [0201]  54.61,114.05 0 top
R4987  10K  [0201]  54.61,114.66 0 top
R4988  10K  [0201]  54.61,115.27 0 top
R4989  10K  [0201]  54.61,115.87 0 top
R4990  10K  [0201]  54.61,116.48 0 top
R4991  10K  [0201]  54.61,117.09 0 top
R4992  10K  [0201]  54.61,117.7 0 top
R4993  10K  [0201]  54.61,118.31 0 top
R4994  10K  [0201]  54.61,118.92 0 top
R4995  10K  [0201]  54.61,119.53 0 top
R4996  10K  [0201]  54.61,120.14 0 top
R4997  10K  [0201]  54.61,120.75 0 top
R4998  10K  [0201]  54.61,121.36 0 top
R4999  10K  [0201]  54.61,121.97 0 top
R5000  10K  [0201]  54.61,122.58 0 top
R5001  10K  [0201]  55.83,1.27 0 top
R5002  10K  [0201]  55.83,1.88 0 top
R5003  10K  [0201]  55.83,2.49 0 top
R5004  10K  [0201]  55.83,3.1 0 top
R5005  10K  [0201]  55.83,3.71 0 top
R5006  10K  [0201]  55.83,4.32 0 top
R5007  10K  [0201]  55.83,4.93 0 top
R5008  10K  [0201]  55.83,5.54 0 top
R5009  10K  [0201]  55.83,6.15 0 top
R5010  10K  [0201]  55.83,6.76 0 top
R5011  10K  [0201]  55.83,7.37 0 top
R5012  10K  [0201]  55.83,7.98 0 top
R5013  10K  [0201]  55.83,8.59 0 top
R5014  10K  [0201]  55.83,9.19 0 top
R5015  10K  [0201]  55.83,9.8 0 top
R5016  10K  [0201]  55.83,10.41 0 top
R5017  10K  [0201]  55.83,11.02 0 top
R5018  10K  [0201]  55.83,11.63 0 top
R5019  10K  [0201]  55.83,12.24 0 top
R5020  10K  [0201]  55.83,12.85 0 top
R5021  10K  [0201]  55.83,13.46 0 top
R5022  10K  [0201]  55.83,14.07 0 top
R5023  10K  [0201]  55.83,14.68 0 top
R5024  10K  [0201]  55.83,15.29 0 top
R5025  10K  [0201]  55.83,15.9 0 top
R5026  10K  [0201]  55.83,16.51 0 top
R5027  10K  [0201]  55.83,17.12 0 top
R5028  10K  [0201]  55.83,17.73 0 top
R5029  10K  [0201]  55.83,18.34 0 top
R5030  10K  [0201]  55.83,18.95 0 top
R5031  10K  [0201]  55.83,19.56 0 top
R5032  10K  [0201]  55.83,20.17 0 top
R5033  10K  [0201]  55.83,20.78 0 top
R5034  10K  [0201]  55.83,21.39 0 top
R5035  10K  [0201]  55.83,22 0 top
R5036  10K  [0201]  55.83,22.61 0 top
R5037  10K  [0201]  55.83,23.22 0 top
R5038  10K  [0201]  55.83,23.83 0 top
R5039  10K  [0201]  55.83,24.43 0 top
R5040  10K  [0201]  55.83,25.04 0 top
R5041  10K  [0201]  55.83,25.65 0 top
R5042  10K  [0201]  55.83,26.26 0 top
R5043  10K  [0201]  55.83,26.87 0 top
R5044  10K  [0201]  55.83,27.48 0 top
R5045  10K  [0201]  55.83,28.09 0 top
R5046  10K  [0201]  55.83,28.7 0 top
R5047  10K  [0201]  55.83,29.31 0 top
R5048  10K  [0201]  55.83,29.92 0 top
R5049  10K  [0201]  55.83,30.53 0 top
R5050  10K  [0201]  55.83,31.14 0 top
R5051  10K  [0201]  55.83,31.75 0 top
R5052  10K  [0201]  55.83,32.36 0 top
R5053  10K  [0201]  55.83,32.97 0 top
R5054  10K  [0201]  55.83,33.58 0 top
R5055  10K  [0201]  55.83,34.19 0 top
R5056  10K  [0201]  55.83,34.8 0 top
R5057  10K  [0201]  55.83,35.41 0 top
R5058  10K  [0201]  55.83,36.02 0 top
R5059  10K  [0201]  55.83,36.63 0 top
R5060  10K  [0201]  55.83,37.24 0 top
R5061  10K  [0201]  55.83,37.85 0 top
R5062  10K  [0201]  55.83,38.46 0 top
R5063  10K  [0201]  55.83,39.07 0 top
R5064  10K  [0201]  55.83,39.67 0 top
R5065  10K  [0201]  55.83,40.28 0 top
R5066  10K  [0201]  55.83,40.89 0 top
R5067  10K  [0201]  55.83,41.5 0 top
R5068  10K  [0201]  55.83,42.11 0 top
R5069  10K  [0201]  55.83,42.72 0 top
R5070  10K  [0201]  55.83,43.33 0 top
R5071  10K  [0201]  55.83,43.94 0 top
R5072  10K  [0201]  55.83,44.55 0 top
R5073  10K  [0201]  55.83,45.16 0 top
R5074  10K  [0201]  55.83,45.77 0 top
R5075  10K  [0201]  55.83,46.38 0 top
R5076  10K  [0201]  55.83,46.99 0 top
R5077  10K  [0201]  55.83,47.6 0 top
R5078  10K  [0201]  55.83,48.21 0 top
R5079  10K  [0201]  55.83,48.82 0 top
R5080  10K  [0201]  55.83,49.43 0 top
R5081  10K  [0201]  55.83,50.04 0 top
R5082  10K  [0201]  55.83,50.65 0 top
R5083  10K  [0201]  55.83,51.26 0 top
R5084  10K  [0201]  55.83,51.87 0 top
R5085  10K  [0201]  55.83,52.48 0 top
R5086  10K  [0201]  55.83,53.09 0 top
R5087  10K  [0201]  55.83,53.7 0 top
R5088  10K  [0201]  55.83,54.31 0 top
R5089  10K  [0201]  55.83,54.91 0 top
R5090  10K  [0201]  55.83,55.52 0 top
R5091  10K  [0201]  55.83,56.13 0 top
R5092  10K  [0201]  55.83,56.74 0 top
R5093  10K  [0201]  55.83,57.35 0 top
R5094  10K  [0201]  55.83,57.96 0 top
R5095  10K  [0201]  55.83,58.57 0 top
R5096  10K  [0201]  55.83,59.18 0 top
R5097  10K  [0201]  55.83,59.79 0 top
R5098  10K  [0201]  55.83,60.4 0 top
R5099  10K  [0201]  55.83,61.01 0 top
R5100  10K  [0201]  55.83,61.62 0 top
R5101  10K  [0201]  55.83,62.23 0 top
R5102  10K  [0201]  55.83,62.84 0 top
R5103  10K  [0201]  55.83,63.45 0 top
R5104  10K  [0201]  55.83,64.06 0 top
R5105  10K  [0201]  55.83,64.67 0 top
R5106  10K  [0201]  55.83,65.28 0 top
R5107  10K  [0201]  55.83,65.89 0 top
R5108  10K  [0201]  55.83,66.5 0 top
R5109  10K  [0201]  55.83,67.11 0 top
R5110  10K  [0201]  55.83,67.72 0 top
R5111  10K  [0201]  55.83,68.33 0 top
R5112  10K  [0201]  55.83,68.94 0 top
R5113  10K  [0201]  55.83,69.55 0 top
R5114  10K  [0201]  55.83,70.15 0 top
R5115  10K  [0201]  55.83,70.76 0 top
R5116  10K  [0201]  55.83,71.37 0 top
R5117  10K  [0201]  55.83,71.98 0 top
R5118  10K  [0201]  55.83,72.59 0 top
R5119  10K  [0201]  55.83,73.2 0 top
R5120  10K  [0201]  55.83,73.81 0 top
R5121  10K  [0201]  55.83,74.42 0 top
R5122  10K  [0201]  55.83,75.03 0 top
R5123  10K  [0201]  55.83,75.64 0 top
R5124  10K  [0201]  55.83,76.25 0 top
R5125  10K  [0201]  55.83,76.86 0 top
R5126  10K  [0201]  55.83,77.47 0 top
R5127  10K  [0201]  55.83,78.08 0 top
R5128  10K  [0201]  55.83,78.69 0 top
R5129  10K  [0201]  55.83,79.3 0 top
R5130  10K  [0201]  55.83,79.91 0 top
R5131  10K  [0201]  55.83,80.52 0 top
R5132  10K  [0201]  55.83,81.13 0 top
R5133  10K  [0201]  55.83,81.74 0 top
R5134  10K  [0201]  55.83,82.35 0 top
R5135  10K  [0201]  55.83,82.96 0 top
R5136  10K  [0201]  55.83,83.57 0 top
R5137  10K  [0201]  55.83,84.18 0 top
R5138  10K  [0201]  55.83,84.79 0 top
R5139  10K  [0201]  55.83,85.39 0 top
R5140  10K  [0201]  55.83,86 0 top
R5141  10K  [0201]  55.83,86.61 0 top
R5142  10K  [0201]  55.83,87.22 0 top
R5143  10K  [0201]  55.83,87.83 0 top
R5144  10K  [0201]  55.83,88.44 0 top
R5145  10K  [0201]  55.83,89.05 0 top
R5146  10K  [0201]  55.83,89.66 0 top
R5147  10K  [0201]  55.83,90.27 0 top
R5148  10K  [0201]  55.83,90.88 0 top
R5149  10K  [0201]  55.83,91.49 0 top
R5150  10K  [0201]  55.83,92.1 0 top
R5151  10K  [0201]  55.83,92.71 0 top
R5152  10K  [0201]  55.83,93.32 0 top
R5153  10K  [0201]  55.83,93.93 0 top
R5154  10K  [0201]  55.83,94.54 0 top
R5155  10K  [0201]  55.83,95.15 0 top
R5156  10K  [0201]  55.83,95.76 0 top
R5157  10K  [0201]  55.83,96.37 0 top
R5158  10K  [0201]  55.83,96.98 0 top
R5159  10K  [0201]  55.83,97.59 0 top
R5160  10K  [0201]  55.83,98.2 0 top
R5161  10K  [0201]  55.83,98.81 0 top
R5162  10K  [0201]  55.83,99.42 0 top
R5163  10K  [0201]  55.83,100.03 0 top
R5164  10K  [0201]  55.83,100.63 0 top
R5165  10K  [0201]  55.83,101.24 0 top
R5166  10K  [0201]  55.83,101.85 0 top
R5167  10K  [0201]  55.83,102.46 0 top
R5168  10K  [0201]  55.83,103.07 0 top
R5169  10K  [0201]  55.83,103.68 0 top
R5170  10K  [0201]  55.83,104.29 0 top
R5171  10K  [0201]  55.83,104.9 0 top
R5172  10K  [0201]  55.83,105.51 0 top
R5173  10K  [0201]  55.83,106.12 0 top
R5174  10K  [0201]  55.83,106.73 0 top
R5175  10K  [0201]  55.83,107.34 0 top
R5176  10K  [0201]  55.83,107.95 0 top
R5177  10K  [0201]  55.83,108.56 0 top
R5178  10K  [0201]  55.83,109.17 0 top
R5179  10K  [0201]  55.83,109.78 0 top
R5180  10K  [0201]  55.83,110.39 0 top
R5181  10K  [0201]  55.83,111 0 top
R5182  10K  [0201]  55.83,111.61 0 top
R5183  10K  [0201]  55.83,112.22 0 top
R5184  10K  [0201]  55.83,112.83 0 top
R5185  10K  [0201]  55.83,113.44 0 top
R5186  10K  [0201]  55.83,114.05 0 top
R5187  10K  [0201]  55.83,114.66 0 top
R5188  10K  [0201]  55.83,115.27 0 top
R5189  10K  [0201]  55.83,115.87 0 top
R5190  10K  [0201]  55.83,116.48 0 top
R5191  10K  [0201]  55.83,117.09 0 top
R5192  10K  [0201]  55.83,117.7 0 top
R5193  10K  [0201]  55.83,118.31 0 top
R5194  10K  [0201]  55.83,118.92 0 top
R5195  10K  [0201]  55.83,119.53 0 top
R5196  10K  [0201]  55.83,120.14 0 top
R5197  10K  [0201]  55.83,120.75 0 top
R5198  10K  [0201]  55.83,121.36 0 top
R5199  10K  [0201]  55.83,121.97 0 top
R5200  10K  [0201]  55.83,122.58 0 top
R5201  10K  [0201]  57.05,1.27 0 top
R5202  10K  [0201]  57.05,1.88 0 top
R5203  10K  [0201]  57.05,2.49 0 top
R5204  10K  [0201]  57.05,3.1 0 top
R5205  10K  [0201]  57.05,3.71 0 top
R5206  10K  [0201]  57.05,4.32 0 top
R5207  10K  [0201]  57.05,4.93 0 top
R5208  10K  [0201]  57.05,5.54 0 top
R5209  10K  [0201]  57.05,6.15 0 top
R5210  10K  [0201]  57.05,6.76 0 top
R5211  10K  [0201]  57.05,7.37 0 top
R5212  10K  [0201]  57.05,7.98 0 top
R5213  10K  [0201]  57.05,8.59 0 top
R5214  10K  [0201]  57.05,9.19 0 top
R5215  10K  [0201]  57.05,9.8 0 top
R5216  10K  [0201]  57.05,10.41 0 top
R5217  10K  [0201]  57.05,11.02 0 top
R5218  10K  [0201]  57.05,11.63 0 top
R5219  10K  [0201]  57.05,12.24 0 top
R5220  10K  [0201]  57.05,12.85 0 top
R5221  10K  [0201]  57.05,13.46 0 top
R5222  10K  [0201]  57.05,14.07 0 top
R5223  10K  [0201]  57.05,14.68 0 top
R5224  10K  [0201]  57.05,15.29 0 top
R5225  10K  [0201]  57.05,15.9 0 top
R5226  10K  [0201]  57.05,16.51 0 top
R5227  10K  [0201]  57.05,17.12 0 top
R5228  10K  [0201]  57.05,17.73 0 top
R5229  10K  [0201]  57.05,18.34 0 top
R5230  10K  [0201]  57.05,18.95 0 top
R5231  10K  [0201]  57.05,19.56 0 top
R5232  10K  [0201]  57.05,20.17 0 top
R5233  10K  [0201]  57.05,20.78 0 top
R5234  10K  [0201]  57.05,21.39 0 top
R5235  10K  [0201]  57.05,22 0 top
R5236  10K  [0201]  57.05,22.61 0 top
R5237  10K  [0201]  57.05,23.22 0 top
R5238  10K  [0201]  57.05,23.83 0 top
R5239  10K  [0201]  57.05,24.43 0 top
R5240  10K  [0201]  57.05,25.04 0 top
R5241  10K  [0201]  57.05,25.65 0 top
R5242  10K  [0201]  57.05,26.26 0 top
R5243  10K  [0201]  57.05,26.87 0 top